# Altium schematic sheet schematic1.SchDoc (part 1 of 3)
size 1651 x 800 mm
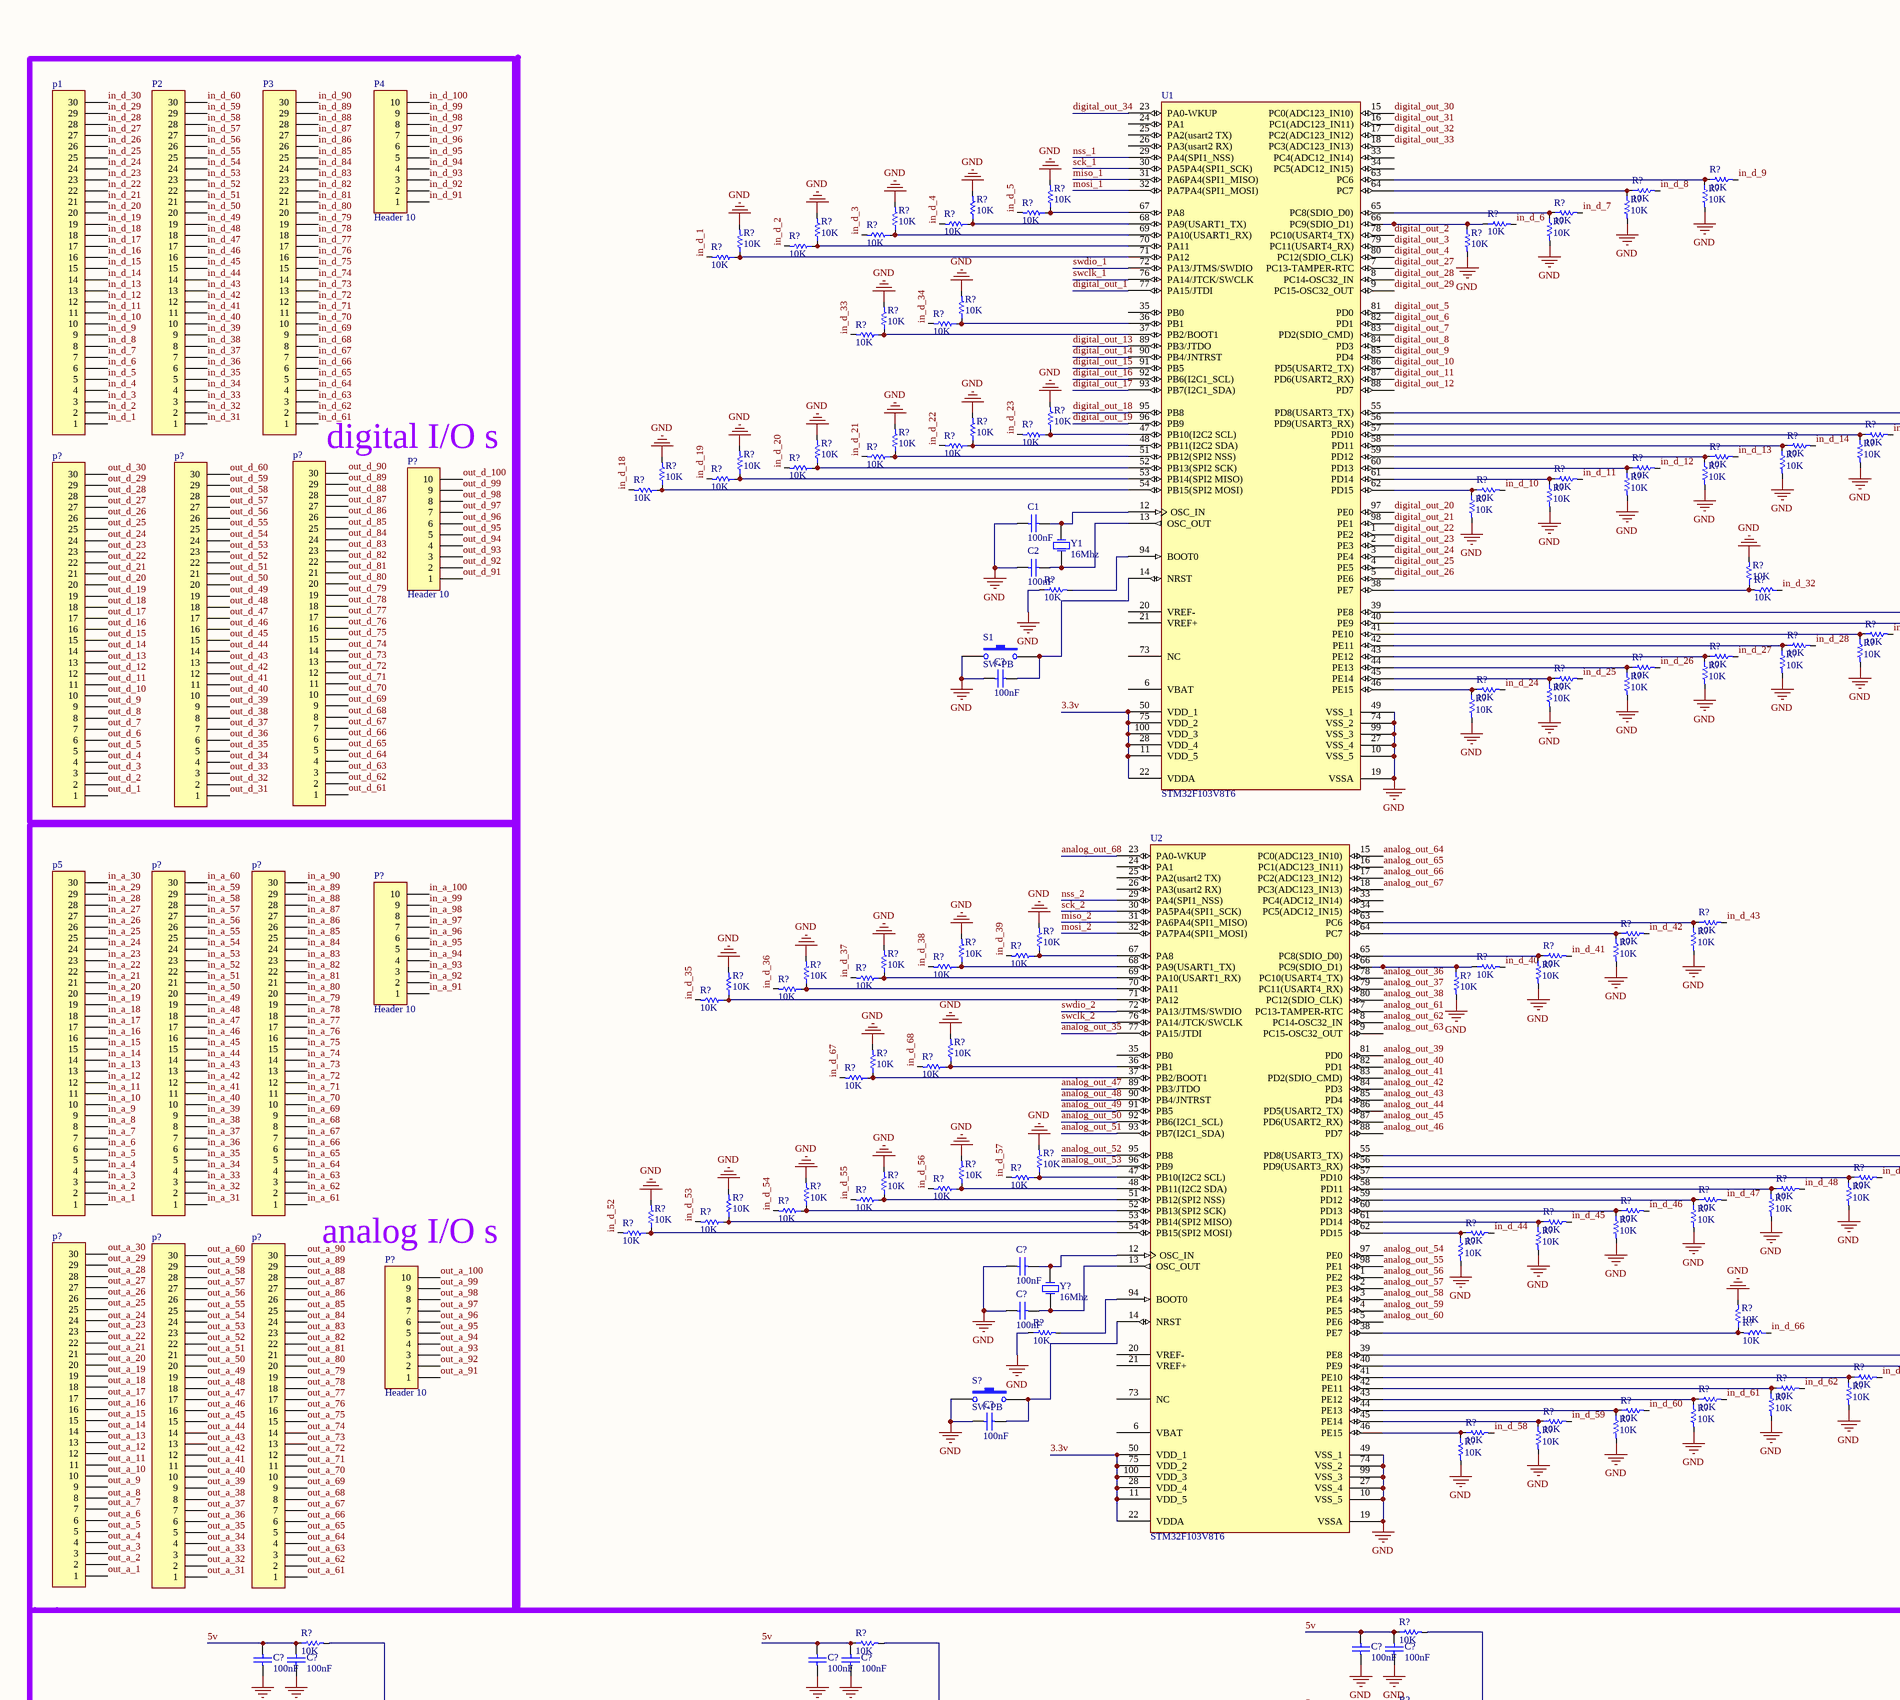
[diagram p0: schematic1.SchDoc, top column 1 of 4]
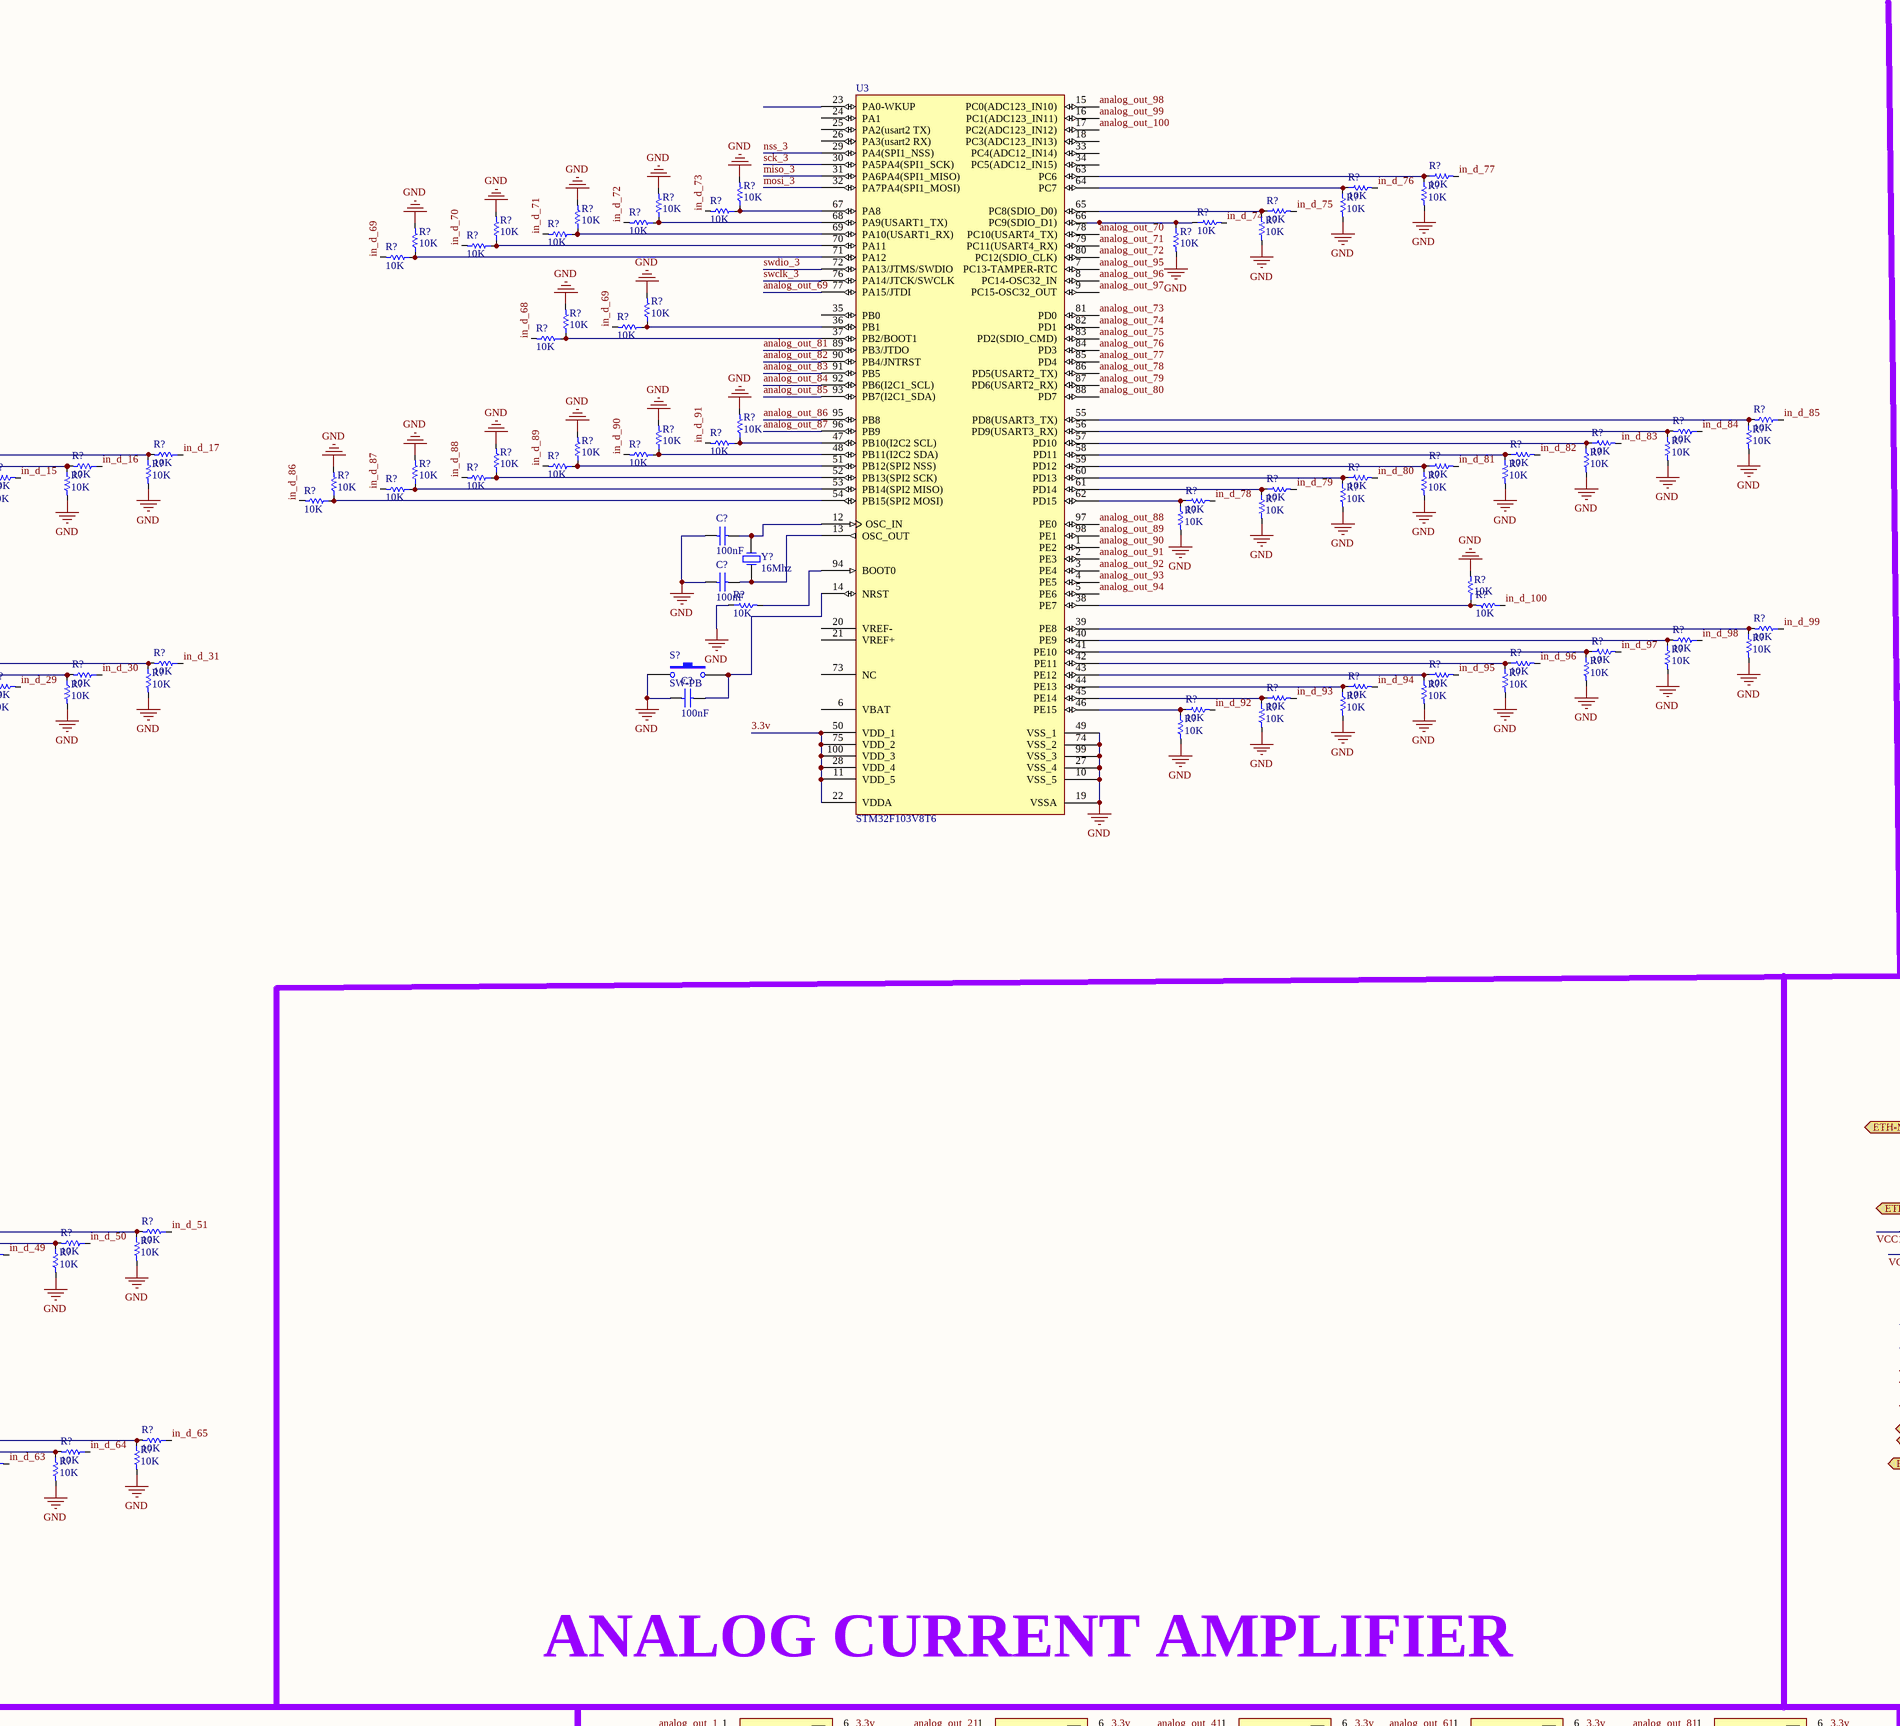
[diagram p1: schematic1.SchDoc, top column 2 of 4]
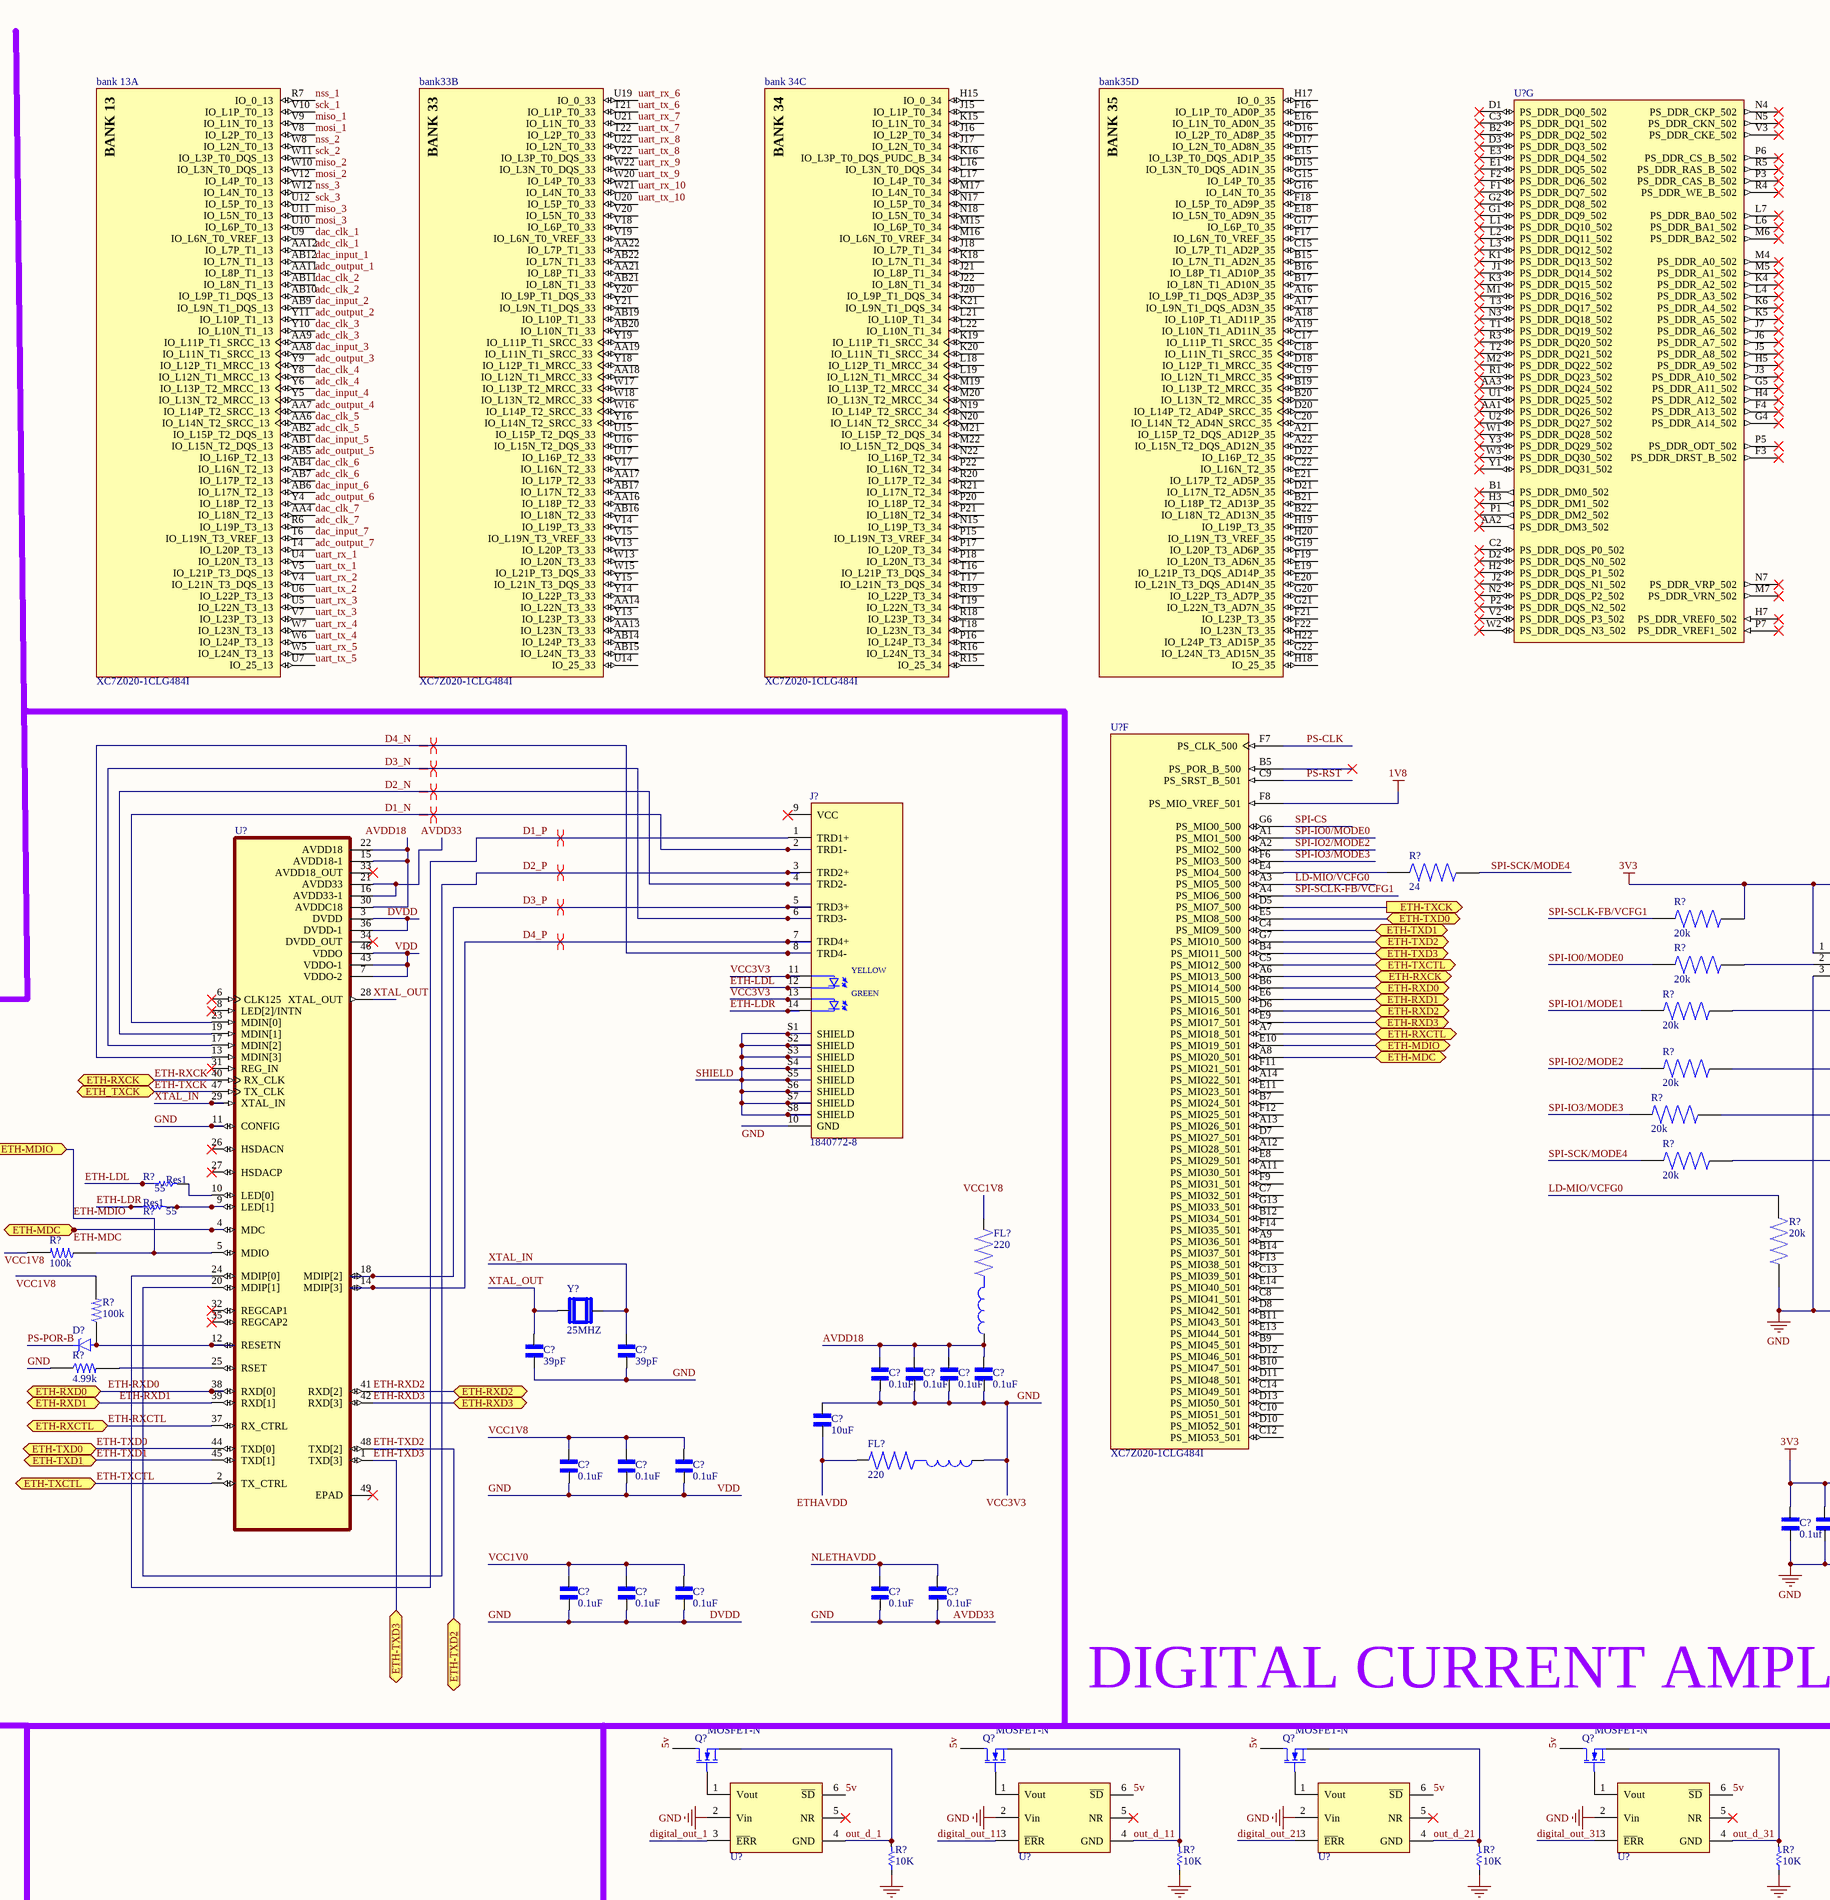
[diagram p2: schematic1.SchDoc, top column 3 of 4]
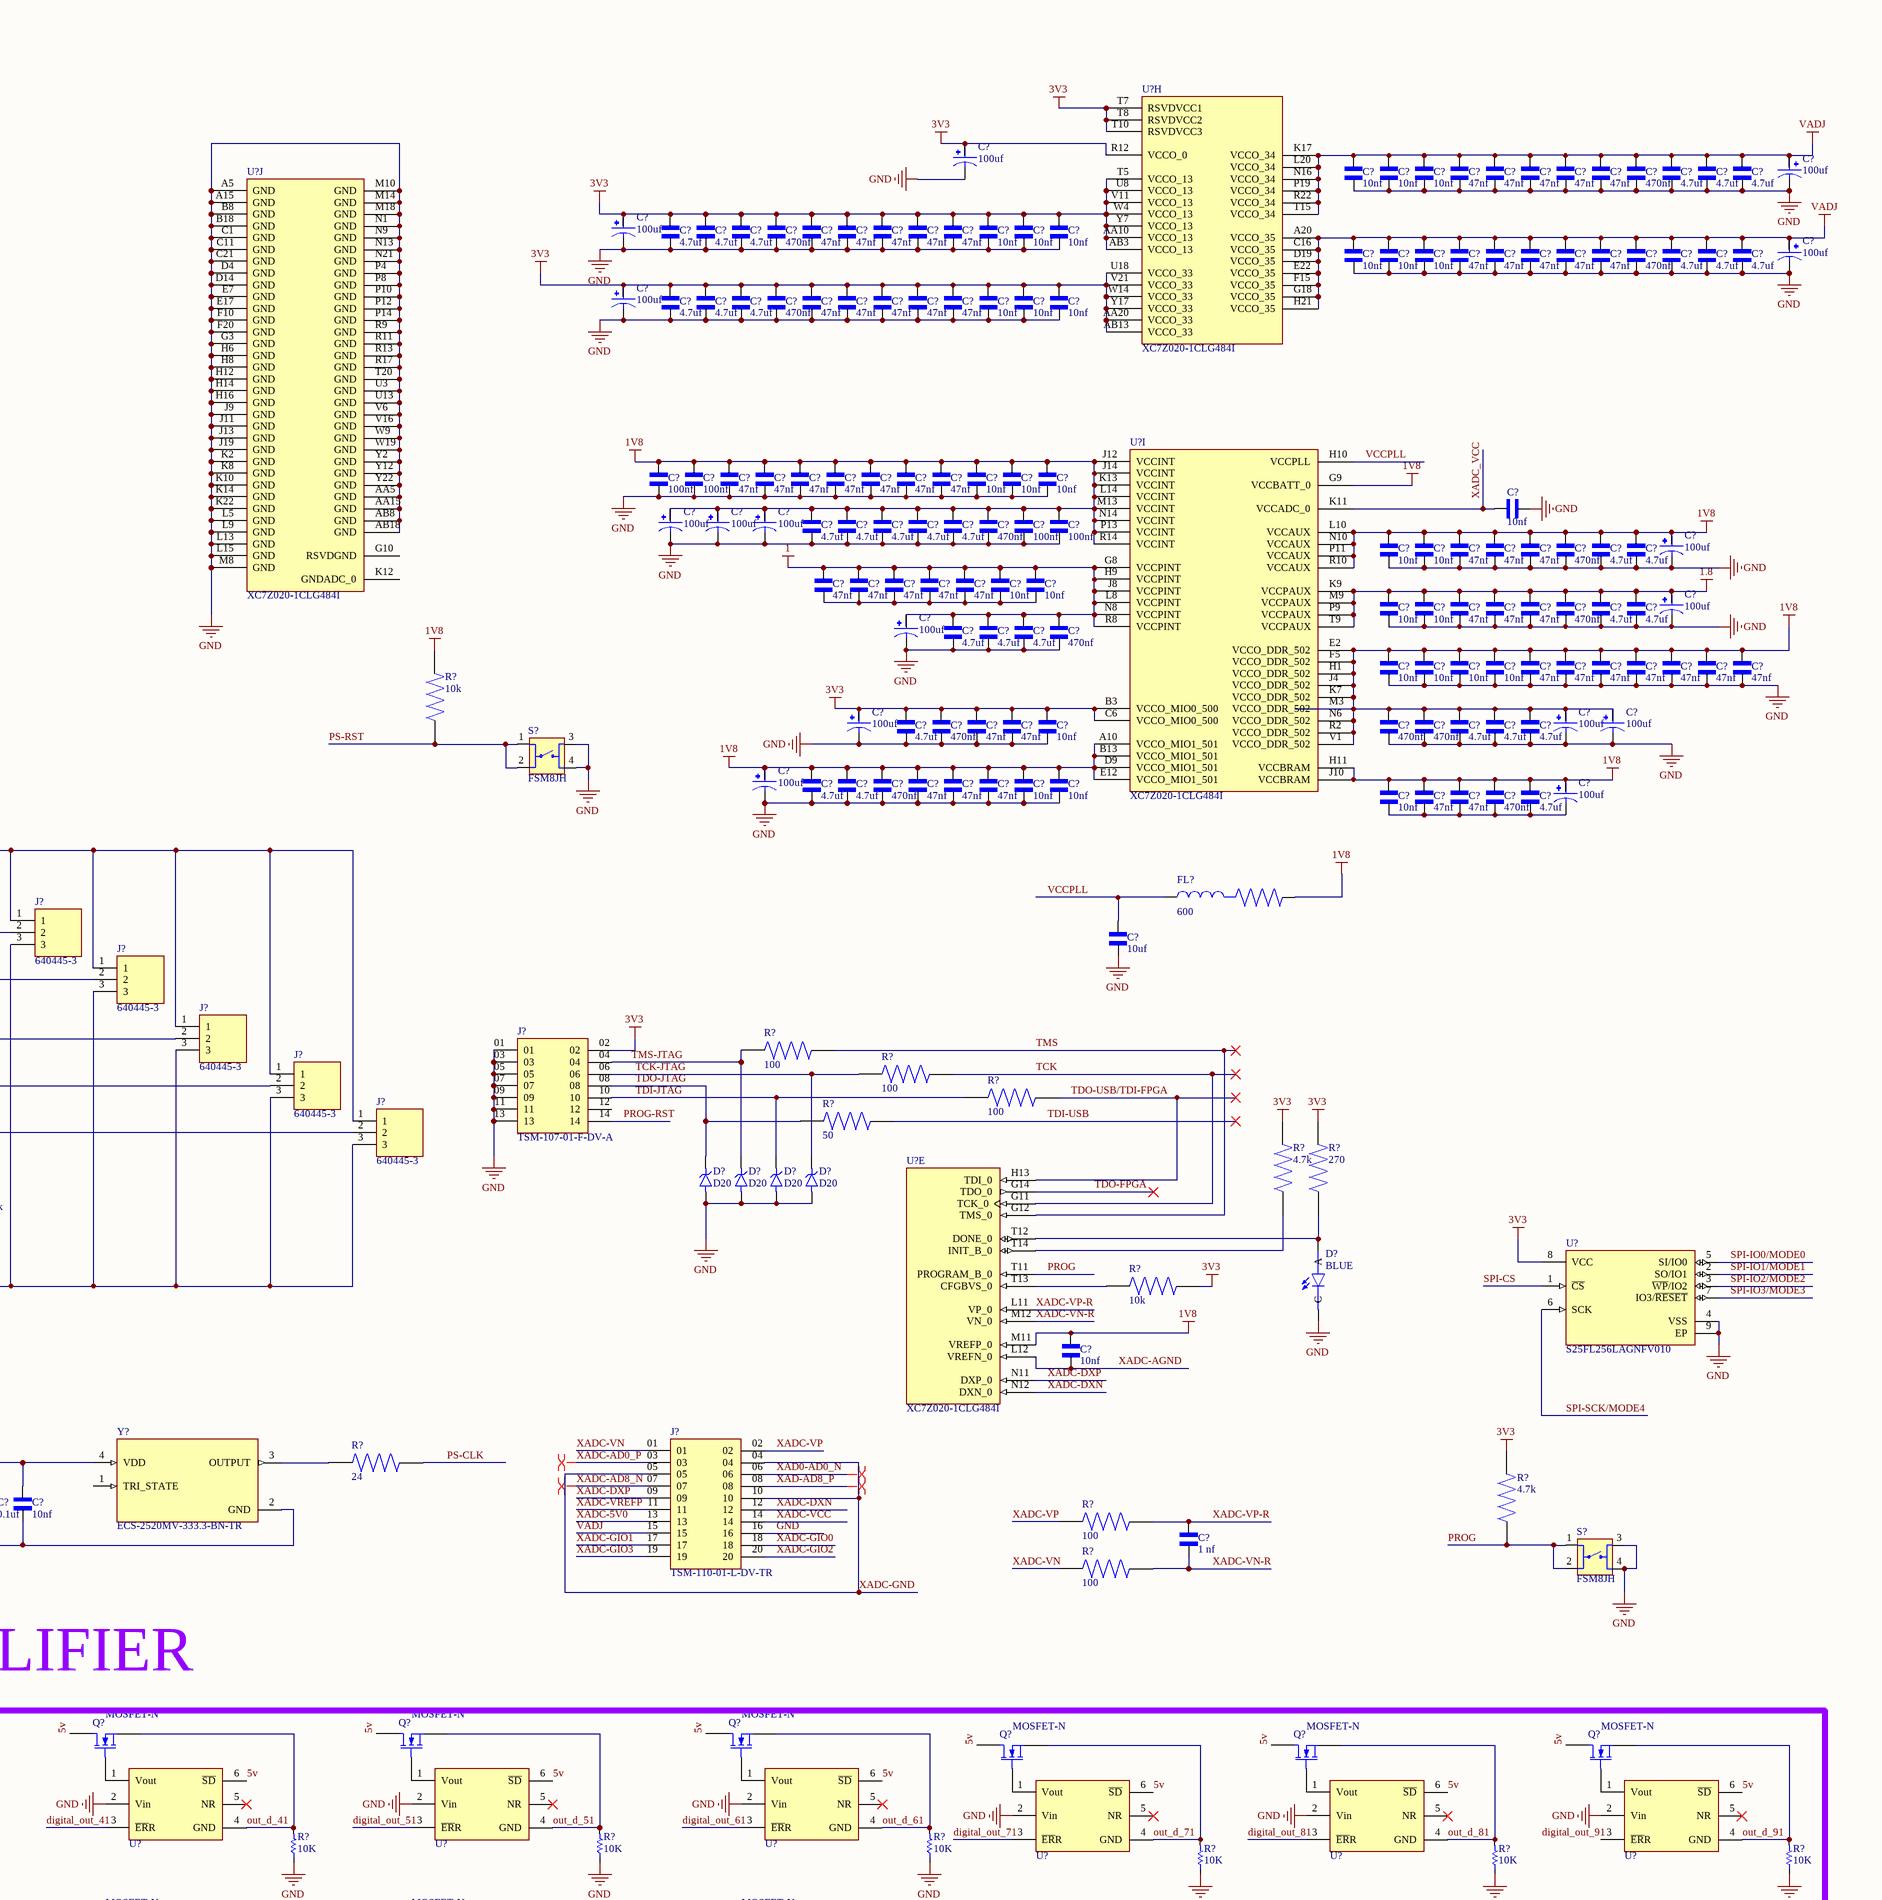
[diagram p3: schematic1.SchDoc, top column 4 of 4]
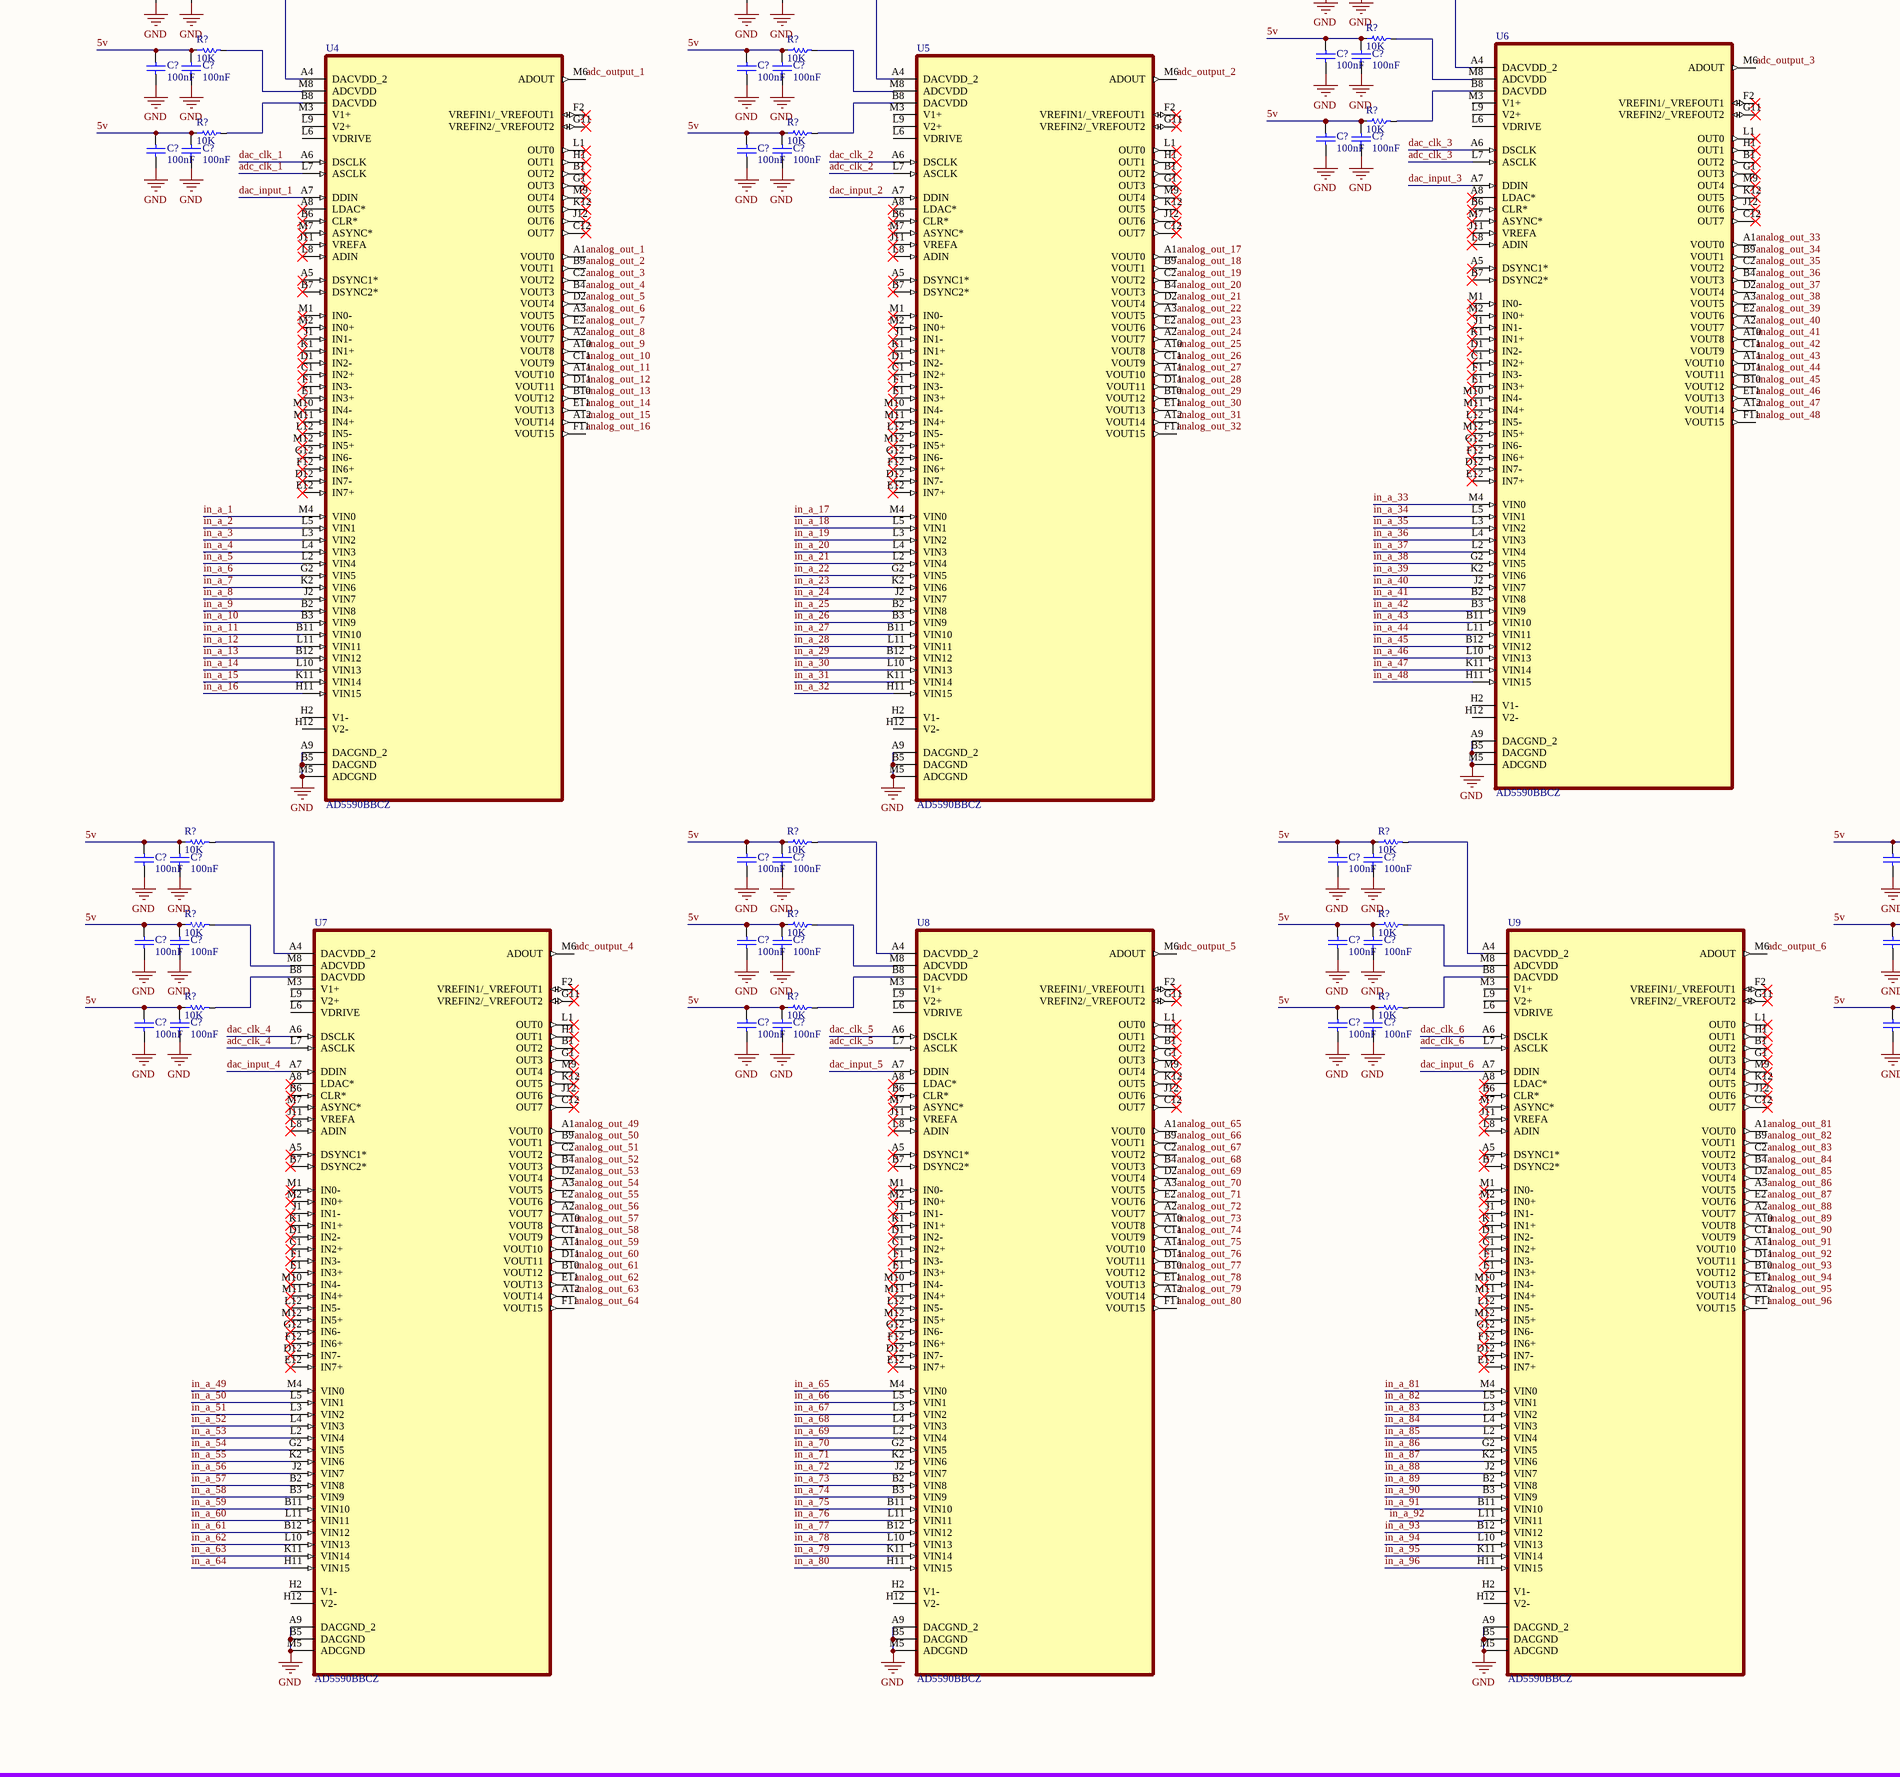
[diagram p4: schematic1.SchDoc, bottom column 1 of 4]
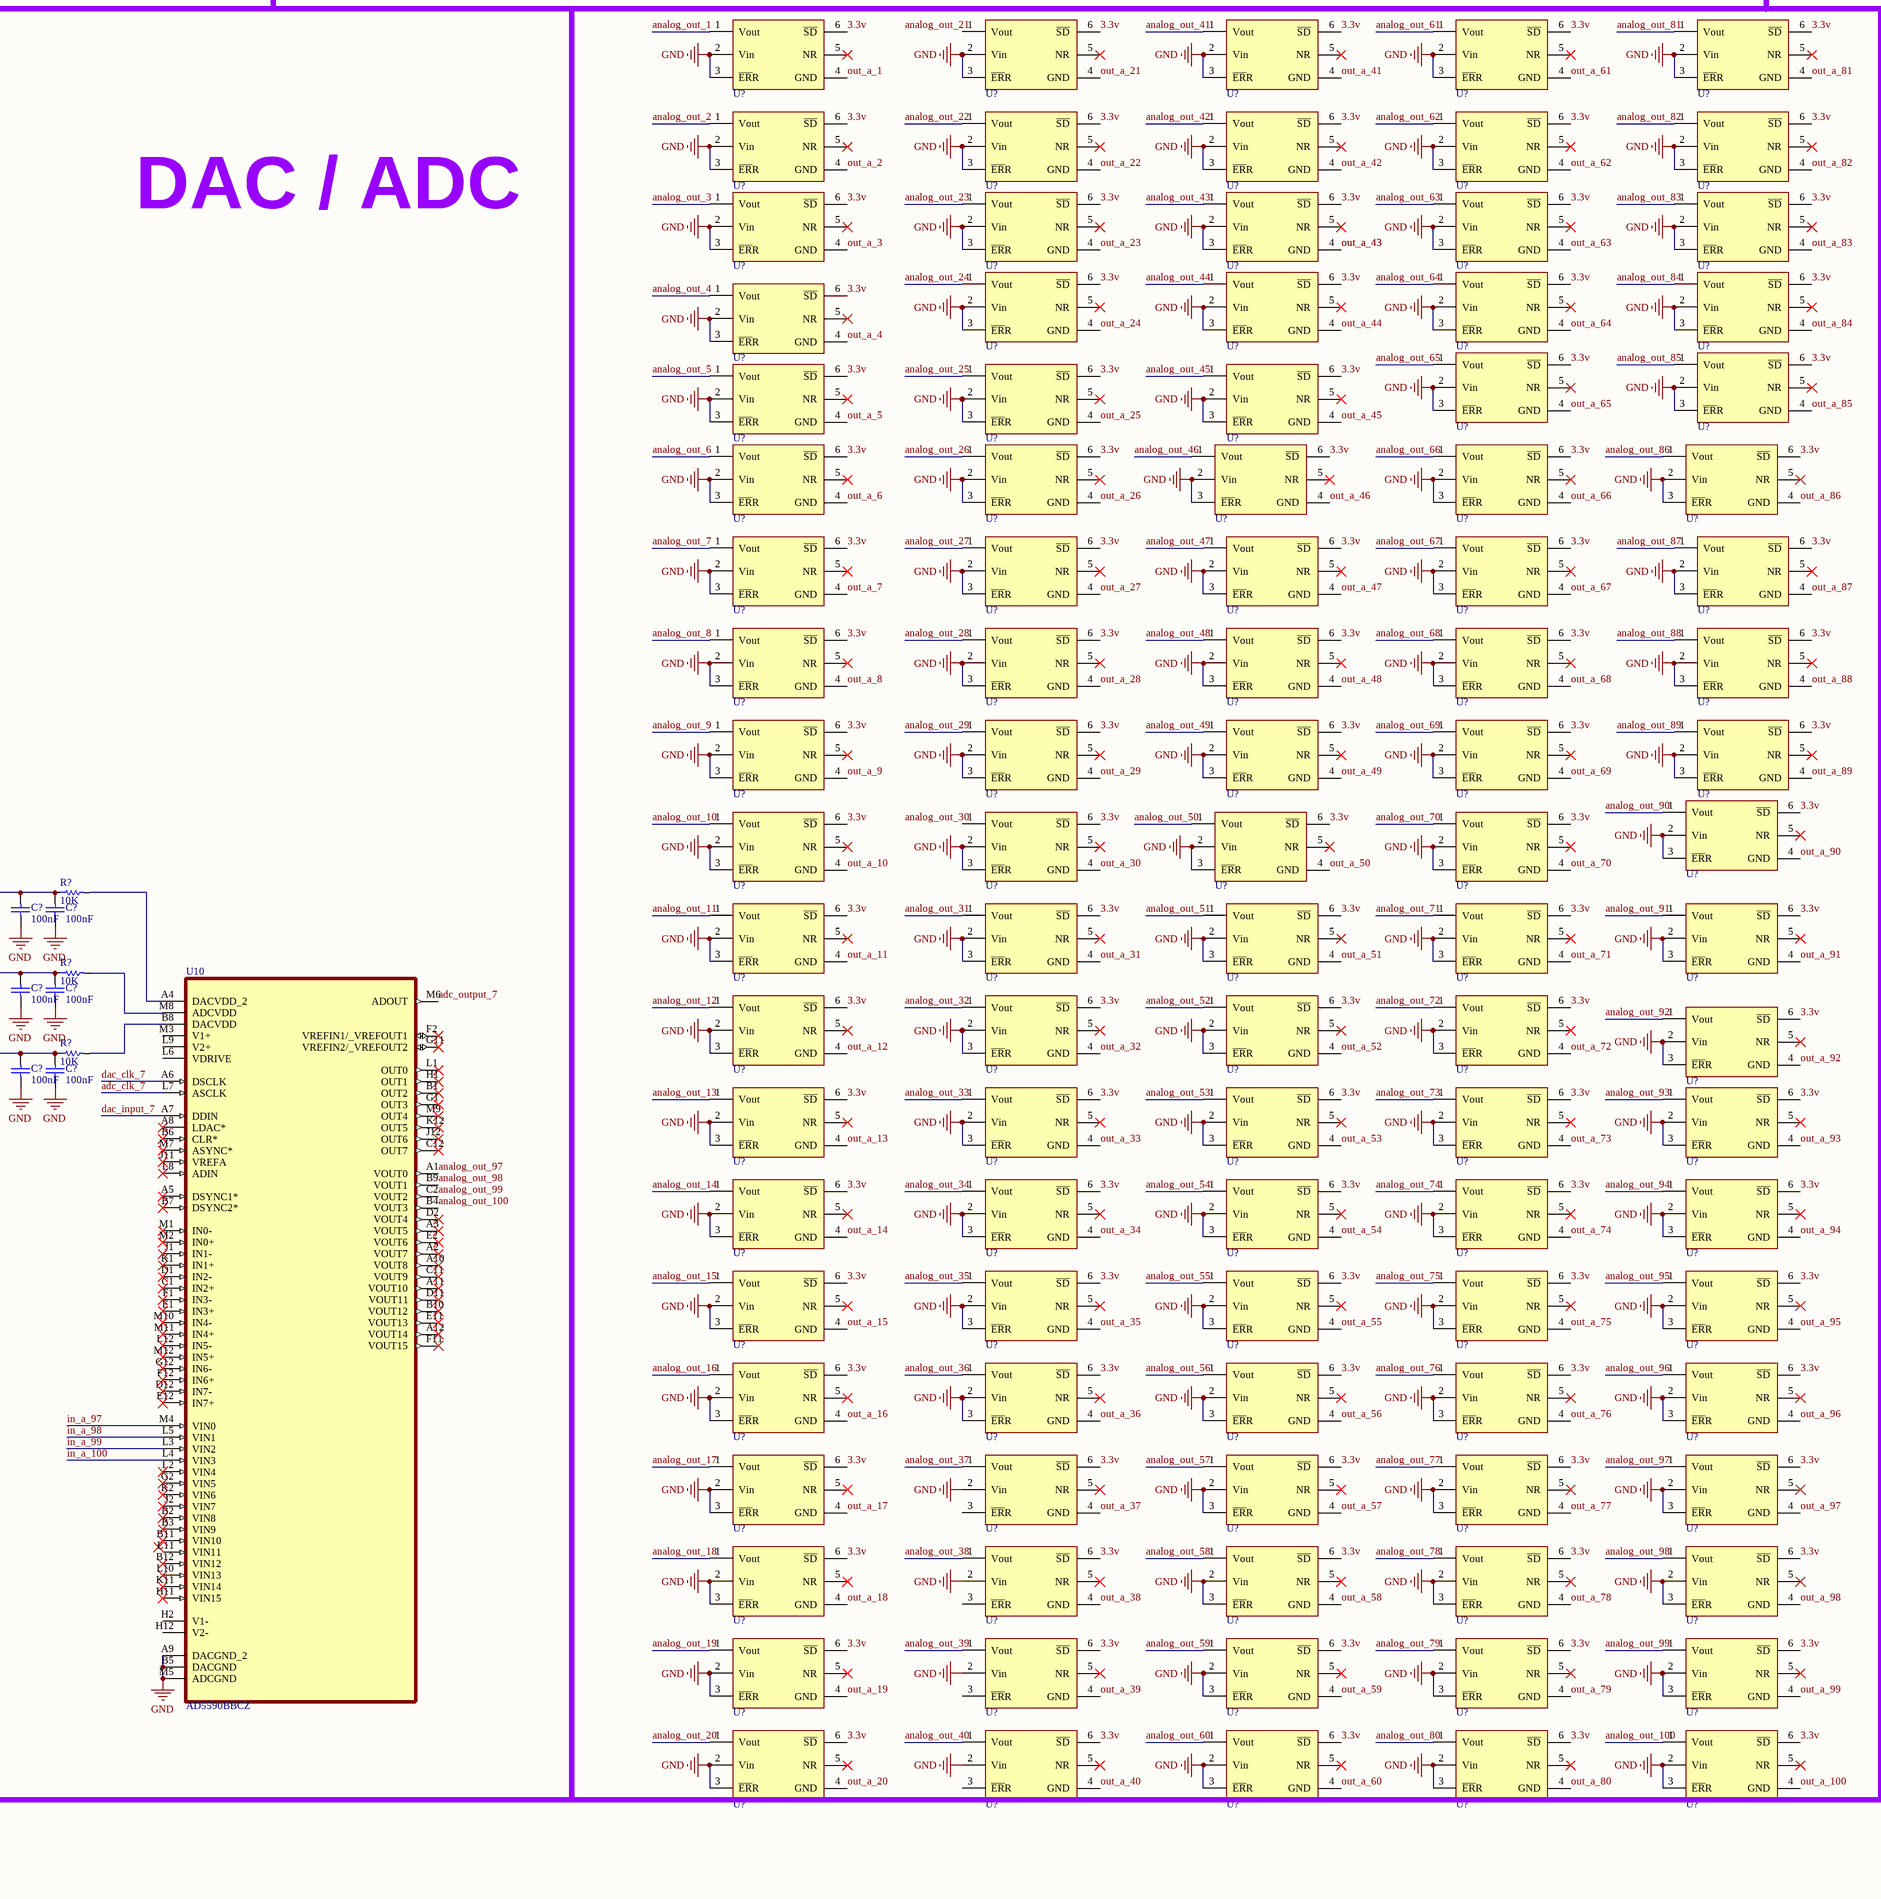
[diagram p5: schematic1.SchDoc, bottom column 2 of 4]